# EAGLE schematic Resistor_Resistor (EAGLE 8.3.0), part 5 of 43
## Parts (continued)
R5862  10K  RESISTOR_0201  [0201]
R5863  10K  RESISTOR_0201  [0201]
R5864  10K  RESISTOR_0201  [0201]
R5865  10K  RESISTOR_0201  [0201]
R5866  10K  RESISTOR_0201  [0201]
R5867  10K  RESISTOR_0201  [0201]
R5868  10K  RESISTOR_0201  [0201]
R5869  10K  RESISTOR_0201  [0201]
R5870  10K  RESISTOR_0201  [0201]
R5871  10K  RESISTOR_0201  [0201]
R5872  10K  RESISTOR_0201  [0201]
R5873  10K  RESISTOR_0201  [0201]
R5874  10K  RESISTOR_0201  [0201]
R5875  10K  RESISTOR_0201  [0201]
R5876  10K  RESISTOR_0201  [0201]
R5877  10K  RESISTOR_0201  [0201]
R5878  10K  RESISTOR_0201  [0201]
R5879  10K  RESISTOR_0201  [0201]
R5880  10K  RESISTOR_0201  [0201]
R5881  10K  RESISTOR_0201  [0201]
R5882  10K  RESISTOR_0201  [0201]
R5883  10K  RESISTOR_0201  [0201]
R5884  10K  RESISTOR_0201  [0201]
R5885  10K  RESISTOR_0201  [0201]
R5886  10K  RESISTOR_0201  [0201]
R5887  10K  RESISTOR_0201  [0201]
R5888  10K  RESISTOR_0201  [0201]
R5889  10K  RESISTOR_0201  [0201]
R5890  10K  RESISTOR_0201  [0201]
R5891  10K  RESISTOR_0201  [0201]
R5892  10K  RESISTOR_0201  [0201]
R5893  10K  RESISTOR_0201  [0201]
R5894  10K  RESISTOR_0201  [0201]
R5895  10K  RESISTOR_0201  [0201]
R5896  10K  RESISTOR_0201  [0201]
R5897  10K  RESISTOR_0201  [0201]
R5898  10K  RESISTOR_0201  [0201]
R5899  10K  RESISTOR_0201  [0201]
R5900  10K  RESISTOR_0201  [0201]
R5901  10K  RESISTOR_0201  [0201]
R5902  10K  RESISTOR_0201  [0201]
R5903  10K  RESISTOR_0201  [0201]
R5904  10K  RESISTOR_0201  [0201]
R5905  10K  RESISTOR_0201  [0201]
R5906  10K  RESISTOR_0201  [0201]
R5907  10K  RESISTOR_0201  [0201]
R5908  10K  RESISTOR_0201  [0201]
R5909  10K  RESISTOR_0201  [0201]
R5910  10K  RESISTOR_0201  [0201]
R5911  10K  RESISTOR_0201  [0201]
R5912  10K  RESISTOR_0201  [0201]
R5913  10K  RESISTOR_0201  [0201]
R5914  10K  RESISTOR_0201  [0201]
R5915  10K  RESISTOR_0201  [0201]
R5916  10K  RESISTOR_0201  [0201]
R5917  10K  RESISTOR_0201  [0201]
R5918  10K  RESISTOR_0201  [0201]
R5919  10K  RESISTOR_0201  [0201]
R5920  10K  RESISTOR_0201  [0201]
R5921  10K  RESISTOR_0201  [0201]
R5922  10K  RESISTOR_0201  [0201]
R5923  10K  RESISTOR_0201  [0201]
R5924  10K  RESISTOR_0201  [0201]
R5925  10K  RESISTOR_0201  [0201]
R5926  10K  RESISTOR_0201  [0201]
R5927  10K  RESISTOR_0201  [0201]
R5928  10K  RESISTOR_0201  [0201]
R5929  10K  RESISTOR_0201  [0201]
R5930  10K  RESISTOR_0201  [0201]
R5931  10K  RESISTOR_0201  [0201]
R5932  10K  RESISTOR_0201  [0201]
R5933  10K  RESISTOR_0201  [0201]
R5934  10K  RESISTOR_0201  [0201]
R5935  10K  RESISTOR_0201  [0201]
R5936  10K  RESISTOR_0201  [0201]
R5937  10K  RESISTOR_0201  [0201]
R5938  10K  RESISTOR_0201  [0201]
R5939  10K  RESISTOR_0201  [0201]
R5940  10K  RESISTOR_0201  [0201]
R5941  10K  RESISTOR_0201  [0201]
R5942  10K  RESISTOR_0201  [0201]
R5943  10K  RESISTOR_0201  [0201]
R5944  10K  RESISTOR_0201  [0201]
R5945  10K  RESISTOR_0201  [0201]
R5946  10K  RESISTOR_0201  [0201]
R5947  10K  RESISTOR_0201  [0201]
R5948  10K  RESISTOR_0201  [0201]
R5949  10K  RESISTOR_0201  [0201]
R5950  10K  RESISTOR_0201  [0201]
R5951  10K  RESISTOR_0201  [0201]
R5952  10K  RESISTOR_0201  [0201]
R5953  10K  RESISTOR_0201  [0201]
R5954  10K  RESISTOR_0201  [0201]
R5955  10K  RESISTOR_0201  [0201]
R5956  10K  RESISTOR_0201  [0201]
R5957  10K  RESISTOR_0201  [0201]
R5958  10K  RESISTOR_0201  [0201]
R5959  10K  RESISTOR_0201  [0201]
R5960  10K  RESISTOR_0201  [0201]
R5961  10K  RESISTOR_0201  [0201]
R5962  10K  RESISTOR_0201  [0201]
R5963  10K  RESISTOR_0201  [0201]
R5964  10K  RESISTOR_0201  [0201]
R5965  10K  RESISTOR_0201  [0201]
R5966  10K  RESISTOR_0201  [0201]
R5967  10K  RESISTOR_0201  [0201]
R5968  10K  RESISTOR_0201  [0201]
R5969  10K  RESISTOR_0201  [0201]
R5970  10K  RESISTOR_0201  [0201]
R5971  10K  RESISTOR_0201  [0201]
R5972  10K  RESISTOR_0201  [0201]
R5973  10K  RESISTOR_0201  [0201]
R5974  10K  RESISTOR_0201  [0201]
R5975  10K  RESISTOR_0201  [0201]
R5976  10K  RESISTOR_0201  [0201]
R5977  10K  RESISTOR_0201  [0201]
R5978  10K  RESISTOR_0201  [0201]
R5979  10K  RESISTOR_0201  [0201]
R5980  10K  RESISTOR_0201  [0201]
R5981  10K  RESISTOR_0201  [0201]
R5982  10K  RESISTOR_0201  [0201]
R5983  10K  RESISTOR_0201  [0201]
R5984  10K  RESISTOR_0201  [0201]
R5985  10K  RESISTOR_0201  [0201]
R5986  10K  RESISTOR_0201  [0201]
R5987  10K  RESISTOR_0201  [0201]
R5988  10K  RESISTOR_0201  [0201]
R5989  10K  RESISTOR_0201  [0201]
R5990  10K  RESISTOR_0201  [0201]
R5991  10K  RESISTOR_0201  [0201]
R5992  10K  RESISTOR_0201  [0201]
R5993  10K  RESISTOR_0201  [0201]
R5994  10K  RESISTOR_0201  [0201]
R5995  10K  RESISTOR_0201  [0201]
R5996  10K  RESISTOR_0201  [0201]
R5997  10K  RESISTOR_0201  [0201]
R5998  10K  RESISTOR_0201  [0201]
R5999  10K  RESISTOR_0201  [0201]
R6000  10K  RESISTOR_0201  [0201]
R6001  10K  RESISTOR_0201  [0201]
R6002  10K  RESISTOR_0201  [0201]
R6003  10K  RESISTOR_0201  [0201]
R6004  10K  RESISTOR_0201  [0201]
R6005  10K  RESISTOR_0201  [0201]
R6006  10K  RESISTOR_0201  [0201]
R6007  10K  RESISTOR_0201  [0201]
R6008  10K  RESISTOR_0201  [0201]
R6009  10K  RESISTOR_0201  [0201]
R6010  10K  RESISTOR_0201  [0201]
R6011  10K  RESISTOR_0201  [0201]
R6012  10K  RESISTOR_0201  [0201]
R6013  10K  RESISTOR_0201  [0201]
R6014  10K  RESISTOR_0201  [0201]
R6015  10K  RESISTOR_0201  [0201]
R6016  10K  RESISTOR_0201  [0201]
R6017  10K  RESISTOR_0201  [0201]
R6018  10K  RESISTOR_0201  [0201]
R6019  10K  RESISTOR_0201  [0201]
R6020  10K  RESISTOR_0201  [0201]
R6021  10K  RESISTOR_0201  [0201]
R6022  10K  RESISTOR_0201  [0201]
R6023  10K  RESISTOR_0201  [0201]
R6024  10K  RESISTOR_0201  [0201]
R6025  10K  RESISTOR_0201  [0201]
R6026  10K  RESISTOR_0201  [0201]
R6027  10K  RESISTOR_0201  [0201]
R6028  10K  RESISTOR_0201  [0201]
R6029  10K  RESISTOR_0201  [0201]
R6030  10K  RESISTOR_0201  [0201]
R6031  10K  RESISTOR_0201  [0201]
R6032  10K  RESISTOR_0201  [0201]
R6033  10K  RESISTOR_0201  [0201]
R6034  10K  RESISTOR_0201  [0201]
R6035  10K  RESISTOR_0201  [0201]
R6036  10K  RESISTOR_0201  [0201]
R6037  10K  RESISTOR_0201  [0201]
R6038  10K  RESISTOR_0201  [0201]
R6039  10K  RESISTOR_0201  [0201]
R6040  10K  RESISTOR_0201  [0201]
R6041  10K  RESISTOR_0201  [0201]
R6042  10K  RESISTOR_0201  [0201]
R6043  10K  RESISTOR_0201  [0201]
R6044  10K  RESISTOR_0201  [0201]
R6045  10K  RESISTOR_0201  [0201]
R6046  10K  RESISTOR_0201  [0201]
R6047  10K  RESISTOR_0201  [0201]
R6048  10K  RESISTOR_0201  [0201]
R6049  10K  RESISTOR_0201  [0201]
R6050  10K  RESISTOR_0201  [0201]
R6051  10K  RESISTOR_0201  [0201]
R6052  10K  RESISTOR_0201  [0201]
R6053  10K  RESISTOR_0201  [0201]
R6054  10K  RESISTOR_0201  [0201]
R6055  10K  RESISTOR_0201  [0201]
R6056  10K  RESISTOR_0201  [0201]
R6057  10K  RESISTOR_0201  [0201]
R6058  10K  RESISTOR_0201  [0201]
R6059  10K  RESISTOR_0201  [0201]
R6060  10K  RESISTOR_0201  [0201]
R6061  10K  RESISTOR_0201  [0201]
R6062  10K  RESISTOR_0201  [0201]
R6063  10K  RESISTOR_0201  [0201]
R6064  10K  RESISTOR_0201  [0201]
R6065  10K  RESISTOR_0201  [0201]
R6066  10K  RESISTOR_0201  [0201]
R6067  10K  RESISTOR_0201  [0201]
R6068  10K  RESISTOR_0201  [0201]
R6069  10K  RESISTOR_0201  [0201]
R6070  10K  RESISTOR_0201  [0201]
R6071  10K  RESISTOR_0201  [0201]
R6072  10K  RESISTOR_0201  [0201]
R6073  10K  RESISTOR_0201  [0201]
R6074  10K  RESISTOR_0201  [0201]
R6075  10K  RESISTOR_0201  [0201]
R6076  10K  RESISTOR_0201  [0201]
R6077  10K  RESISTOR_0201  [0201]
R6078  10K  RESISTOR_0201  [0201]
R6079  10K  RESISTOR_0201  [0201]
R6080  10K  RESISTOR_0201  [0201]
R6081  10K  RESISTOR_0201  [0201]
R6082  10K  RESISTOR_0201  [0201]
R6083  10K  RESISTOR_0201  [0201]
R6084  10K  RESISTOR_0201  [0201]
R6085  10K  RESISTOR_0201  [0201]
R6086  10K  RESISTOR_0201  [0201]
R6087  10K  RESISTOR_0201  [0201]
R6088  10K  RESISTOR_0201  [0201]
R6089  10K  RESISTOR_0201  [0201]
R6090  10K  RESISTOR_0201  [0201]
R6091  10K  RESISTOR_0201  [0201]
R6092  10K  RESISTOR_0201  [0201]
R6093  10K  RESISTOR_0201  [0201]
R6094  10K  RESISTOR_0201  [0201]
R6095  10K  RESISTOR_0201  [0201]
R6096  10K  RESISTOR_0201  [0201]
R6097  10K  RESISTOR_0201  [0201]
R6098  10K  RESISTOR_0201  [0201]
R6099  10K  RESISTOR_0201  [0201]
R6100  10K  RESISTOR_0201  [0201]
R6101  10K  RESISTOR_0201  [0201]
R6102  10K  RESISTOR_0201  [0201]
R6103  10K  RESISTOR_0201  [0201]
R6104  10K  RESISTOR_0201  [0201]
R6105  10K  RESISTOR_0201  [0201]
R6106  10K  RESISTOR_0201  [0201]
R6107  10K  RESISTOR_0201  [0201]
R6108  10K  RESISTOR_0201  [0201]
R6109  10K  RESISTOR_0201  [0201]
R6110  10K  RESISTOR_0201  [0201]
R6111  10K  RESISTOR_0201  [0201]
R6112  10K  RESISTOR_0201  [0201]
R6113  10K  RESISTOR_0201  [0201]
R6114  10K  RESISTOR_0201  [0201]
R6115  10K  RESISTOR_0201  [0201]
R6116  10K  RESISTOR_0201  [0201]
R6117  10K  RESISTOR_0201  [0201]
R6118  10K  RESISTOR_0201  [0201]
R6119  10K  RESISTOR_0201  [0201]
R6120  10K  RESISTOR_0201  [0201]
R6121  10K  RESISTOR_0201  [0201]
R6122  10K  RESISTOR_0201  [0201]
R6123  10K  RESISTOR_0201  [0201]
R6124  10K  RESISTOR_0201  [0201]
R6125  10K  RESISTOR_0201  [0201]
R6126  10K  RESISTOR_0201  [0201]
R6127  10K  RESISTOR_0201  [0201]
R6128  10K  RESISTOR_0201  [0201]
R6129  10K  RESISTOR_0201  [0201]
R6130  10K  RESISTOR_0201  [0201]
R6131  10K  RESISTOR_0201  [0201]
R6132  10K  RESISTOR_0201  [0201]
R6133  10K  RESISTOR_0201  [0201]
R6134  10K  RESISTOR_0201  [0201]
R6135  10K  RESISTOR_0201  [0201]
R6136  10K  RESISTOR_0201  [0201]
R6137  10K  RESISTOR_0201  [0201]
R6138  10K  RESISTOR_0201  [0201]
R6139  10K  RESISTOR_0201  [0201]
R6140  10K  RESISTOR_0201  [0201]
R6141  10K  RESISTOR_0201  [0201]
R6142  10K  RESISTOR_0201  [0201]
R6143  10K  RESISTOR_0201  [0201]
R6144  10K  RESISTOR_0201  [0201]
R6145  10K  RESISTOR_0201  [0201]
R6146  10K  RESISTOR_0201  [0201]
R6147  10K  RESISTOR_0201  [0201]
R6148  10K  RESISTOR_0201  [0201]
R6149  10K  RESISTOR_0201  [0201]
R6150  10K  RESISTOR_0201  [0201]
R6151  10K  RESISTOR_0201  [0201]
R6152  10K  RESISTOR_0201  [0201]
R6153  10K  RESISTOR_0201  [0201]
R6154  10K  RESISTOR_0201  [0201]
R6155  10K  RESISTOR_0201  [0201]
R6156  10K  RESISTOR_0201  [0201]
R6157  10K  RESISTOR_0201  [0201]
R6158  10K  RESISTOR_0201  [0201]
R6159  10K  RESISTOR_0201  [0201]
R6160  10K  RESISTOR_0201  [0201]
R6161  10K  RESISTOR_0201  [0201]
R6162  10K  RESISTOR_0201  [0201]
R6163  10K  RESISTOR_0201  [0201]
R6164  10K  RESISTOR_0201  [0201]
R6165  10K  RESISTOR_0201  [0201]
R6166  10K  RESISTOR_0201  [0201]
R6167  10K  RESISTOR_0201  [0201]
R6168  10K  RESISTOR_0201  [0201]
R6169  10K  RESISTOR_0201  [0201]
R6170  10K  RESISTOR_0201  [0201]
R6171  10K  RESISTOR_0201  [0201]
R6172  10K  RESISTOR_0201  [0201]
R6173  10K  RESISTOR_0201  [0201]
R6174  10K  RESISTOR_0201  [0201]
R6175  10K  RESISTOR_0201  [0201]
R6176  10K  RESISTOR_0201  [0201]
R6177  10K  RESISTOR_0201  [0201]
R6178  10K  RESISTOR_0201  [0201]
R6179  10K  RESISTOR_0201  [0201]
R6180  10K  RESISTOR_0201  [0201]
R6181  10K  RESISTOR_0201  [0201]
R6182  10K  RESISTOR_0201  [0201]
R6183  10K  RESISTOR_0201  [0201]
R6184  10K  RESISTOR_0201  [0201]
R6185  10K  RESISTOR_0201  [0201]
R6186  10K  RESISTOR_0201  [0201]
R6187  10K  RESISTOR_0201  [0201]
R6188  10K  RESISTOR_0201  [0201]
R6189  10K  RESISTOR_0201  [0201]
R6190  10K  RESISTOR_0201  [0201]
R6191  10K  RESISTOR_0201  [0201]
R6192  10K  RESISTOR_0201  [0201]
R6193  10K  RESISTOR_0201  [0201]
R6194  10K  RESISTOR_0201  [0201]
R6195  10K  RESISTOR_0201  [0201]
R6196  10K  RESISTOR_0201  [0201]
R6197  10K  RESISTOR_0201  [0201]
R6198  10K  RESISTOR_0201  [0201]
R6199  10K  RESISTOR_0201  [0201]
R6200  10K  RESISTOR_0201  [0201]
R6201  10K  RESISTOR_0201  [0201]
R6202  10K  RESISTOR_0201  [0201]
R6203  10K  RESISTOR_0201  [0201]
R6204  10K  RESISTOR_0201  [0201]
R6205  10K  RESISTOR_0201  [0201]
R6206  10K  RESISTOR_0201  [0201]
R6207  10K  RESISTOR_0201  [0201]
R6208  10K  RESISTOR_0201  [0201]
R6209  10K  RESISTOR_0201  [0201]
R6210  10K  RESISTOR_0201  [0201]
R6211  10K  RESISTOR_0201  [0201]
R6212  10K  RESISTOR_0201  [0201]
R6213  10K  RESISTOR_0201  [0201]
R6214  10K  RESISTOR_0201  [0201]
R6215  10K  RESISTOR_0201  [0201]
R6216  10K  RESISTOR_0201  [0201]
R6217  10K  RESISTOR_0201  [0201]
R6218  10K  RESISTOR_0201  [0201]
R6219  10K  RESISTOR_0201  [0201]
R6220  10K  RESISTOR_0201  [0201]
R6221  10K  RESISTOR_0201  [0201]
R6222  10K  RESISTOR_0201  [0201]
R6223  10K  RESISTOR_0201  [0201]
R6224  10K  RESISTOR_0201  [0201]
R6225  10K  RESISTOR_0201  [0201]
R6226  10K  RESISTOR_0201  [0201]
R6227  10K  RESISTOR_0201  [0201]
R6228  10K  RESISTOR_0201  [0201]
R6229  10K  RESISTOR_0201  [0201]
R6230  10K  RESISTOR_0201  [0201]
R6231  10K  RESISTOR_0201  [0201]
R6232  10K  RESISTOR_0201  [0201]
R6233  10K  RESISTOR_0201  [0201]
R6234  10K  RESISTOR_0201  [0201]
R6235  10K  RESISTOR_0201  [0201]
R6236  10K  RESISTOR_0201  [0201]
R6237  10K  RESISTOR_0201  [0201]
R6238  10K  RESISTOR_0201  [0201]
R6239  10K  RESISTOR_0201  [0201]
R6240  10K  RESISTOR_0201  [0201]
R6241  10K  RESISTOR_0201  [0201]
R6242  10K  RESISTOR_0201  [0201]
R6243  10K  RESISTOR_0201  [0201]
R6244  10K  RESISTOR_0201  [0201]
R6245  10K  RESISTOR_0201  [0201]
R6246  10K  RESISTOR_0201  [0201]
R6247  10K  RESISTOR_0201  [0201]
R6248  10K  RESISTOR_0201  [0201]
R6249  10K  RESISTOR_0201  [0201]
R6250  10K  RESISTOR_0201  [0201]
R6251  10K  RESISTOR_0201  [0201]
R6252  10K  RESISTOR_0201  [0201]
R6253  10K  RESISTOR_0201  [0201]
R6254  10K  RESISTOR_0201  [0201]
R6255  10K  RESISTOR_0201  [0201]
R6256  10K  RESISTOR_0201  [0201]
R6257  10K  RESISTOR_0201  [0201]
R6258  10K  RESISTOR_0201  [0201]
R6259  10K  RESISTOR_0201  [0201]
R6260  10K  RESISTOR_0201  [0201]
R6261  10K  RESISTOR_0201  [0201]
R6262  10K  RESISTOR_0201  [0201]
R6263  10K  RESISTOR_0201  [0201]
R6264  10K  RESISTOR_0201  [0201]
R6265  10K  RESISTOR_0201  [0201]
R6266  10K  RESISTOR_0201  [0201]
R6267  10K  RESISTOR_0201  [0201]
R6268  10K  RESISTOR_0201  [0201]
R6269  10K  RESISTOR_0201  [0201]
R6270  10K  RESISTOR_0201  [0201]
R6271  10K  RESISTOR_0201  [0201]
R6272  10K  RESISTOR_0201  [0201]
R6273  10K  RESISTOR_0201  [0201]
R6274  10K  RESISTOR_0201  [0201]
R6275  10K  RESISTOR_0201  [0201]
R6276  10K  RESISTOR_0201  [0201]
R6277  10K  RESISTOR_0201  [0201]
R6278  10K  RESISTOR_0201  [0201]
R6279  10K  RESISTOR_0201  [0201]
R6280  10K  RESISTOR_0201  [0201]
R6281  10K  RESISTOR_0201  [0201]
R6282  10K  RESISTOR_0201  [0201]
R6283  10K  RESISTOR_0201  [0201]
R6284  10K  RESISTOR_0201  [0201]
R6285  10K  RESISTOR_0201  [0201]
R6286  10K  RESISTOR_0201  [0201]
R6287  10K  RESISTOR_0201  [0201]
R6288  10K  RESISTOR_0201  [0201]
R6289  10K  RESISTOR_0201  [0201]
R6290  10K  RESISTOR_0201  [0201]
R6291  10K  RESISTOR_0201  [0201]
R6292  10K  RESISTOR_0201  [0201]
R6293  10K  RESISTOR_0201  [0201]
R6294  10K  RESISTOR_0201  [0201]
R6295  10K  RESISTOR_0201  [0201]
R6296  10K  RESISTOR_0201  [0201]
R6297  10K  RESISTOR_0201  [0201]
R6298  10K  RESISTOR_0201  [0201]
R6299  10K  RESISTOR_0201  [0201]
R6300  10K  RESISTOR_0201  [0201]
R6301  10K  RESISTOR_0201  [0201]
R6302  10K  RESISTOR_0201  [0201]
R6303  10K  RESISTOR_0201  [0201]
R6304  10K  RESISTOR_0201  [0201]
R6305  10K  RESISTOR_0201  [0201]
R6306  10K  RESISTOR_0201  [0201]
R6307  10K  RESISTOR_0201  [0201]
R6308  10K  RESISTOR_0201  [0201]
R6309  10K  RESISTOR_0201  [0201]
R6310  10K  RESISTOR_0201  [0201]
R6311  10K  RESISTOR_0201  [0201]
R6312  10K  RESISTOR_0201  [0201]
R6313  10K  RESISTOR_0201  [0201]
R6314  10K  RESISTOR_0201  [0201]
R6315  10K  RESISTOR_0201  [0201]
R6316  10K  RESISTOR_0201  [0201]
R6317  10K  RESISTOR_0201  [0201]
R6318  10K  RESISTOR_0201  [0201]
R6319  10K  RESISTOR_0201  [0201]
R6320  10K  RESISTOR_0201  [0201]
R6321  10K  RESISTOR_0201  [0201]
R6322  10K  RESISTOR_0201  [0201]
R6323  10K  RESISTOR_0201  [0201]
R6324  10K  RESISTOR_0201  [0201]
R6325  10K  RESISTOR_0201  [0201]
R6326  10K  RESISTOR_0201  [0201]
R6327  10K  RESISTOR_0201  [0201]
R6328  10K  RESISTOR_0201  [0201]
R6329  10K  RESISTOR_0201  [0201]
R6330  10K  RESISTOR_0201  [0201]
R6331  10K  RESISTOR_0201  [0201]
R6332  10K  RESISTOR_0201  [0201]
R6333  10K  RESISTOR_0201  [0201]
R6334  10K  RESISTOR_0201  [0201]
R6335  10K  RESISTOR_0201  [0201]
R6336  10K  RESISTOR_0201  [0201]
R6337  10K  RESISTOR_0201  [0201]
R6338  10K  RESISTOR_0201  [0201]
R6339  10K  RESISTOR_0201  [0201]
R6340  10K  RESISTOR_0201  [0201]
R6341  10K  RESISTOR_0201  [0201]
R6342  10K  RESISTOR_0201  [0201]
R6343  10K  RESISTOR_0201  [0201]
R6344  10K  RESISTOR_0201  [0201]
R6345  10K  RESISTOR_0201  [0201]
R6346  10K  RESISTOR_0201  [0201]
R6347  10K  RESISTOR_0201  [0201]
R6348  10K  RESISTOR_0201  [0201]
R6349  10K  RESISTOR_0201  [0201]
R6350  10K  RESISTOR_0201  [0201]
R6351  10K  RESISTOR_0201  [0201]
R6352  10K  RESISTOR_0201  [0201]
R6353  10K  RESISTOR_0201  [0201]
R6354  10K  RESISTOR_0201  [0201]
R6355  10K  RESISTOR_0201  [0201]
R6356  10K  RESISTOR_0201  [0201]
R6357  10K  RESISTOR_0201  [0201]
R6358  10K  RESISTOR_0201  [0201]
R6359  10K  RESISTOR_0201  [0201]
R6360  10K  RESISTOR_0201  [0201]
R6361  10K  RESISTOR_0201  [0201]
R6362  10K  RESISTOR_0201  [0201]
R6363  10K  RESISTOR_0201  [0201]
R6364  10K  RESISTOR_0201  [0201]
R6365  10K  RESISTOR_0201  [0201]
R6366  10K  RESISTOR_0201  [0201]
R6367  10K  RESISTOR_0201  [0201]
R6368  10K  RESISTOR_0201  [0201]
R6369  10K  RESISTOR_0201  [0201]
R6370  10K  RESISTOR_0201  [0201]
R6371  10K  RESISTOR_0201  [0201]
R6372  10K  RESISTOR_0201  [0201]
R6373  10K  RESISTOR_0201  [0201]
R6374  10K  RESISTOR_0201  [0201]
R6375  10K  RESISTOR_0201  [0201]
R6376  10K  RESISTOR_0201  [0201]
R6377  10K  RESISTOR_0201  [0201]
R6378  10K  RESISTOR_0201  [0201]
R6379  10K  RESISTOR_0201  [0201]
R6380  10K  RESISTOR_0201  [0201]
R6381  10K  RESISTOR_0201  [0201]
R6382  10K  RESISTOR_0201  [0201]
R6383  10K  RESISTOR_0201  [0201]
R6384  10K  RESISTOR_0201  [0201]
R6385  10K  RESISTOR_0201  [0201]
R6386  10K  RESISTOR_0201  [0201]
R6387  10K  RESISTOR_0201  [0201]
R6388  10K  RESISTOR_0201  [0201]
R6389  10K  RESISTOR_0201  [0201]
R6390  10K  RESISTOR_0201  [0201]
R6391  10K  RESISTOR_0201  [0201]
R6392  10K  RESISTOR_0201  [0201]
R6393  10K  RESISTOR_0201  [0201]
R6394  10K  RESISTOR_0201  [0201]
R6395  10K  RESISTOR_0201  [0201]
R6396  10K  RESISTOR_0201  [0201]
R6397  10K  RESISTOR_0201  [0201]
R6398  10K  RESISTOR_0201  [0201]
R6399  10K  RESISTOR_0201  [0201]
R6400  10K  RESISTOR_0201  [0201]
R6401  10K  RESISTOR_0201  [0201]
R6402  10K  RESISTOR_0201  [0201]
R6403  10K  RESISTOR_0201  [0201]
R6404  10K  RESISTOR_0201  [0201]
R6405  10K  RESISTOR_0201  [0201]
R6406  10K  RESISTOR_0201  [0201]
R6407  10K  RESISTOR_0201  [0201]
R6408  10K  RESISTOR_0201  [0201]
R6409  10K  RESISTOR_0201  [0201]
R6410  10K  RESISTOR_0201  [0201]
R6411  10K  RESISTOR_0201  [0201]
R6412  10K  RESISTOR_0201  [0201]
R6413  10K  RESISTOR_0201  [0201]
R6414  10K  RESISTOR_0201  [0201]
R6415  10K  RESISTOR_0201  [0201]
R6416  10K  RESISTOR_0201  [0201]
R6417  10K  RESISTOR_0201  [0201]
R6418  10K  RESISTOR_0201  [0201]
R6419  10K  RESISTOR_0201  [0201]
R6420  10K  RESISTOR_0201  [0201]
R6421  10K  RESISTOR_0201  [0201]
R6422  10K  RESISTOR_0201  [0201]
R6423  10K  RESISTOR_0201  [0201]
R6424  10K  RESISTOR_0201  [0201]
R6425  10K  RESISTOR_0201  [0201]
R6426  10K  RESISTOR_0201  [0201]
R6427  10K  RESISTOR_0201  [0201]
R6428  10K  RESISTOR_0201  [0201]
R6429  10K  RESISTOR_0201  [0201]
R6430  10K  RESISTOR_0201  [0201]
R6431  10K  RESISTOR_0201  [0201]
R6432  10K  RESISTOR_0201  [0201]
R6433  10K  RESISTOR_0201  [0201]
R6434  10K  RESISTOR_0201  [0201]
R6435  10K  RESISTOR_0201  [0201]
R6436  10K  RESISTOR_0201  [0201]
R6437  10K  RESISTOR_0201  [0201]
R6438  10K  RESISTOR_0201  [0201]
R6439  10K  RESISTOR_0201  [0201]
R6440  10K  RESISTOR_0201  [0201]
R6441  10K  RESISTOR_0201  [0201]
R6442  10K  RESISTOR_0201  [0201]
R6443  10K  RESISTOR_0201  [0201]
R6444  10K  RESISTOR_0201  [0201]
R6445  10K  RESISTOR_0201  [0201]
R6446  10K  RESISTOR_0201  [0201]
R6447  10K  RESISTOR_0201  [0201]
R6448  10K  RESISTOR_0201  [0201]
R6449  10K  RESISTOR_0201  [0201]
R6450  10K  RESISTOR_0201  [0201]
R6451  10K  RESISTOR_0201  [0201]
R6452  10K  RESISTOR_0201  [0201]
R6453  10K  RESISTOR_0201  [0201]
R6454  10K  RESISTOR_0201  [0201]
R6455  10K  RESISTOR_0201  [0201]
R6456  10K  RESISTOR_0201  [0201]
R6457  10K  RESISTOR_0201  [0201]
R6458  10K  RESISTOR_0201  [0201]
R6459  10K  RESISTOR_0201  [0201]
R6460  10K  RESISTOR_0201  [0201]
R6461  10K  RESISTOR_0201  [0201]
R6462  10K  RESISTOR_0201  [0201]
R6463  10K  RESISTOR_0201  [0201]
R6464  10K  RESISTOR_0201  [0201]
R6465  10K  RESISTOR_0201  [0201]
R6466  10K  RESISTOR_0201  [0201]
R6467  10K  RESISTOR_0201  [0201]
R6468  10K  RESISTOR_0201  [0201]
R6469  10K  RESISTOR_0201  [0201]
R6470  10K  RESISTOR_0201  [0201]
R6471  10K  RESISTOR_0201  [0201]
R6472  10K  RESISTOR_0201  [0201]
R6473  10K  RESISTOR_0201  [0201]
R6474  10K  RESISTOR_0201  [0201]
R6475  10K  RESISTOR_0201  [0201]
R6476  10K  RESISTOR_0201  [0201]
R6477  10K  RESISTOR_0201  [0201]
R6478  10K  RESISTOR_0201  [0201]
R6479  10K  RESISTOR_0201  [0201]
R6480  10K  RESISTOR_0201  [0201]
R6481  10K  RESISTOR_0201  [0201]
R6482  10K  RESISTOR_0201  [0201]
R6483  10K  RESISTOR_0201  [0201]
R6484  10K  RESISTOR_0201  [0201]
R6485  10K  RESISTOR_0201  [0201]
R6486  10K  RESISTOR_0201  [0201]
R6487  10K  RESISTOR_0201  [0201]
R6488  10K  RESISTOR_0201  [0201]
R6489  10K  RESISTOR_0201  [0201]
R6490  10K  RESISTOR_0201  [0201]
R6491  10K  RESISTOR_0201  [0201]
R6492  10K  RESISTOR_0201  [0201]
R6493  10K  RESISTOR_0201  [0201]
R6494  10K  RESISTOR_0201  [0201]
R6495  10K  RESISTOR_0201  [0201]
R6496  10K  RESISTOR_0201  [0201]
R6497  10K  RESISTOR_0201  [0201]
R6498  10K  RESISTOR_0201  [0201]
R6499  10K  RESISTOR_0201  [0201]
R6500  10K  RESISTOR_0201  [0201]
R6501  10K  RESISTOR_0201  [0201]
R6502  10K  RESISTOR_0201  [0201]
R6503  10K  RESISTOR_0201  [0201]
R6504  10K  RESISTOR_0201  [0201]
R6505  10K  RESISTOR_0201  [0201]
R6506  10K  RESISTOR_0201  [0201]
R6507  10K  RESISTOR_0201  [0201]
R6508  10K  RESISTOR_0201  [0201]
R6509  10K  RESISTOR_0201  [0201]
R6510  10K  RESISTOR_0201  [0201]
R6511  10K  RESISTOR_0201  [0201]
R6512  10K  RESISTOR_0201  [0201]
R6513  10K  RESISTOR_0201  [0201]
R6514  10K  RESISTOR_0201  [0201]
R6515  10K  RESISTOR_0201  [0201]
R6516  10K  RESISTOR_0201  [0201]
R6517  10K  RESISTOR_0201  [0201]
R6518  10K  RESISTOR_0201  [0201]
R6519  10K  RESISTOR_0201  [0201]
R6520  10K  RESISTOR_0201  [0201]
R6521  10K  RESISTOR_0201  [0201]
R6522  10K  RESISTOR_0201  [0201]
R6523  10K  RESISTOR_0201  [0201]
R6524  10K  RESISTOR_0201  [0201]
R6525  10K  RESISTOR_0201  [0201]
R6526  10K  RESISTOR_0201  [0201]
R6527  10K  RESISTOR_0201  [0201]
R6528  10K  RESISTOR_0201  [0201]
R6529  10K  RESISTOR_0201  [0201]
R6530  10K  RESISTOR_0201  [0201]
R6531  10K  RESISTOR_0201  [0201]
R6532  10K  RESISTOR_0201  [0201]
R6533  10K  RESISTOR_0201  [0201]
R6534  10K  RESISTOR_0201  [0201]
R6535  10K  RESISTOR_0201  [0201]
R6536  10K  RESISTOR_0201  [0201]
R6537  10K  RESISTOR_0201  [0201]
R6538  10K  RESISTOR_0201  [0201]
R6539  10K  RESISTOR_0201  [0201]
R6540  10K  RESISTOR_0201  [0201]
R6541  10K  RESISTOR_0201  [0201]
R6542  10K  RESISTOR_0201  [0201]
R6543  10K  RESISTOR_0201  [0201]
R6544  10K  RESISTOR_0201  [0201]
R6545  10K  RESISTOR_0201  [0201]
R6546  10K  RESISTOR_0201  [0201]
R6547  10K  RESISTOR_0201  [0201]
R6548  10K  RESISTOR_0201  [0201]
R6549  10K  RESISTOR_0201  [0201]
R6550  10K  RESISTOR_0201  [0201]
R6551  10K  RESISTOR_0201  [0201]
R6552  10K  RESISTOR_0201  [0201]
R6553  10K  RESISTOR_0201  [0201]
R6554  10K  RESISTOR_0201  [0201]
R6555  10K  RESISTOR_0201  [0201]
R6556  10K  RESISTOR_0201  [0201]
R6557  10K  RESISTOR_0201  [0201]
R6558  10K  RESISTOR_0201  [0201]
R6559  10K  RESISTOR_0201  [0201]
R6560  10K  RESISTOR_0201  [0201]
R6561  10K  RESISTOR_0201  [0201]
R6562  10K  RESISTOR_0201  [0201]
R6563  10K  RESISTOR_0201  [0201]
R6564  10K  RESISTOR_0201  [0201]
R6565  10K  RESISTOR_0201  [0201]
R6566  10K  RESISTOR_0201  [0201]
R6567  10K  RESISTOR_0201  [0201]
R6568  10K  RESISTOR_0201  [0201]
R6569  10K  RESISTOR_0201  [0201]
R6570  10K  RESISTOR_0201  [0201]
R6571  10K  RESISTOR_0201  [0201]
R6572  10K  RESISTOR_0201  [0201]
R6573  10K  RESISTOR_0201  [0201]
R6574  10K  RESISTOR_0201  [0201]
R6575  10K  RESISTOR_0201  [0201]
R6576  10K  RESISTOR_0201  [0201]
R6577  10K  RESISTOR_0201  [0201]
R6578  10K  RESISTOR_0201  [0201]
R6579  10K  RESISTOR_0201  [0201]
R6580  10K  RESISTOR_0201  [0201]
R6581  10K  RESISTOR_0201  [0201]
R6582  10K  RESISTOR_0201  [0201]
R6583  10K  RESISTOR_0201  [0201]
R6584  10K  RESISTOR_0201  [0201]
R6585  10K  RESISTOR_0201  [0201]
R6586  10K  RESISTOR_0201  [0201]
R6587  10K  RESISTOR_0201  [0201]
R6588  10K  RESISTOR_0201  [0201]
R6589  10K  RESISTOR_0201  [0201]
R6590  10K  RESISTOR_0201  [0201]
R6591  10K  RESISTOR_0201  [0201]